# EasyEDA Pro project Jarvis.eprj, board PCB60
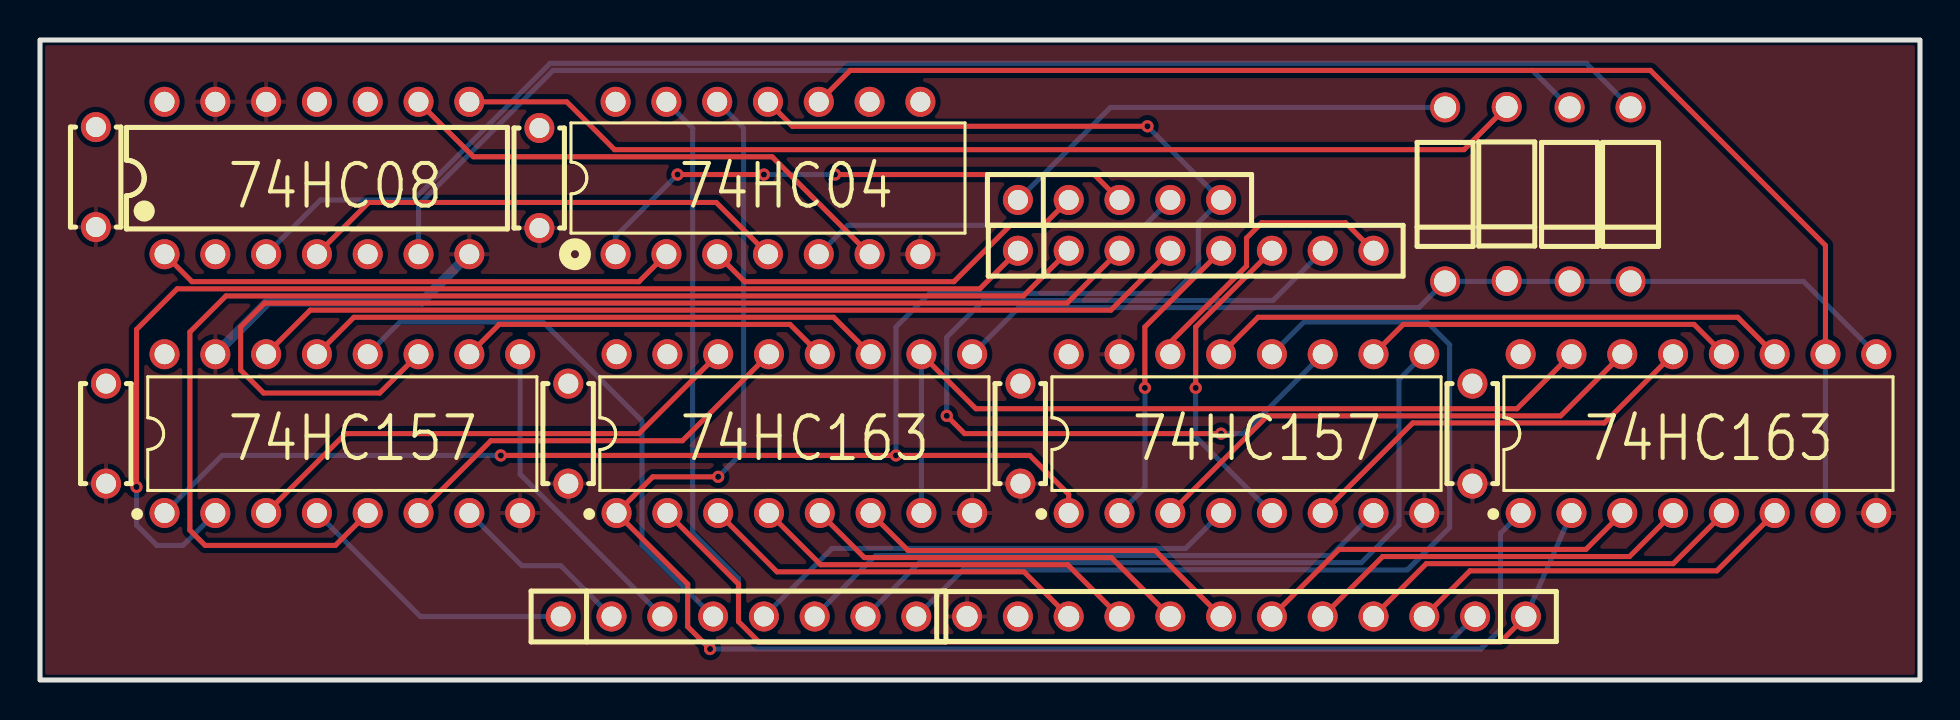
[diagram p12: board, top side]
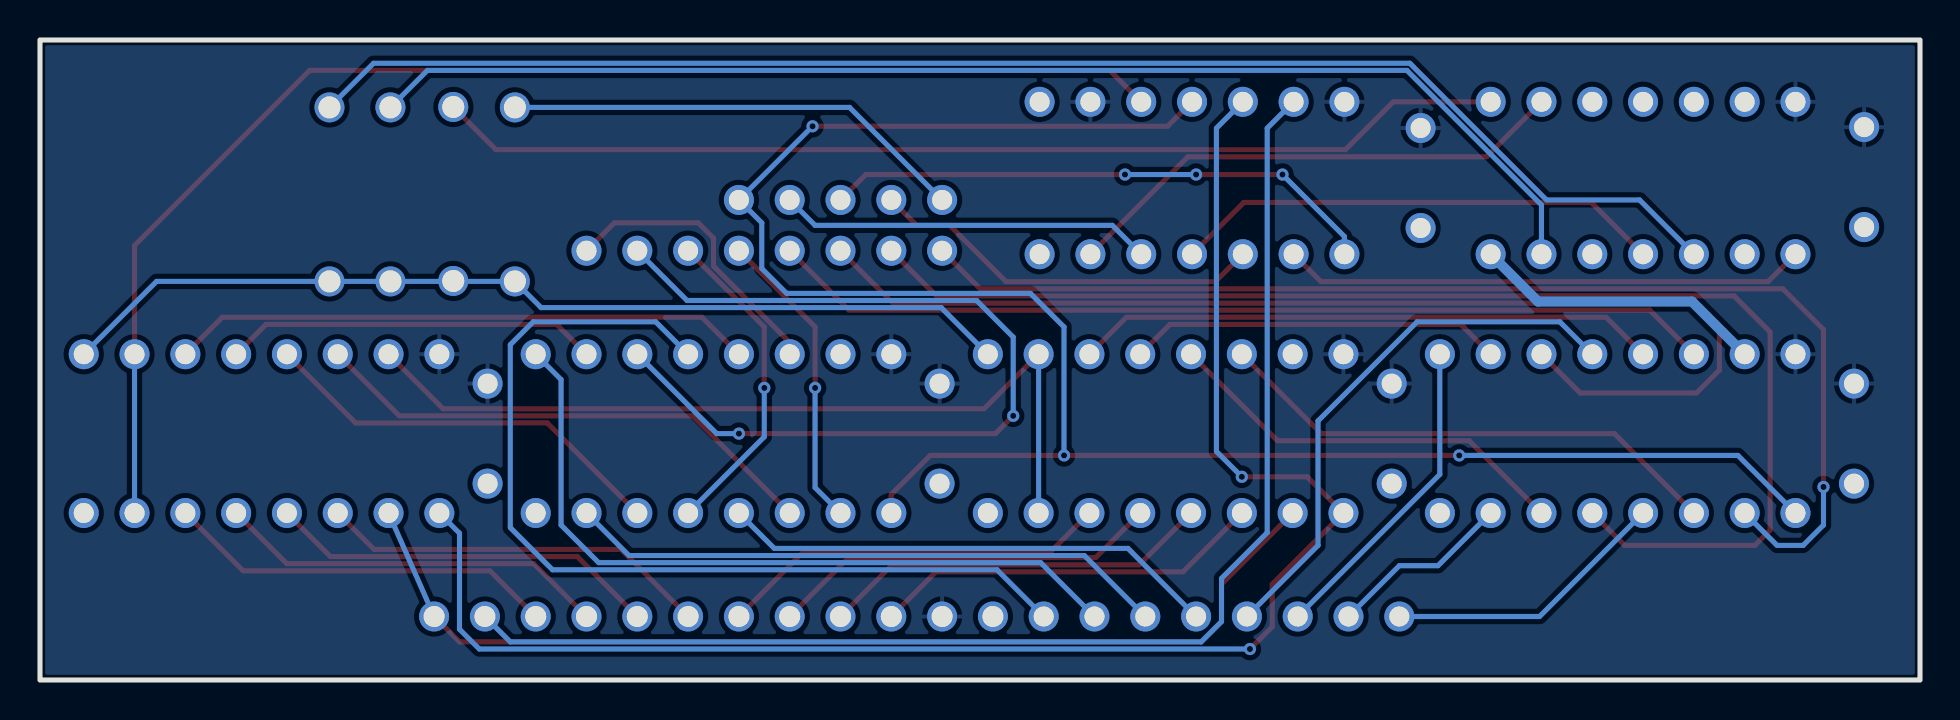
[diagram p13: board, bottom side, seen from below]

Outline 94 x 32 mm; copper layers: Top Layer, Bottom Layer. Coordinates in mm from the lower left corner of the outline.
Outline path: rectangle 0,32 94,0
Stack: Top Layer 0.035mm / Dielectric1 1.51mm FR4 er 4.5 / Bottom Layer 0.035mm

## Design rules (mm)
template: JLCPCB Capability(Two Layers Board)
spacing copperThickness1oz (default): track to track 0.102, other pairs 0.152 to 0.3
spacing copperThickness2oz: track to track 0.203, other pairs 0.152 to 0.3
track width copperThickness1oz (default): min 0.127, default 0.254, max 2.54
track width copperThickness2oz: min 0.203, default 0.254, max 2.54
differential pair differentialPair (default): width min 0.127, default 0.254, max 2.54; gap min 0.152, default 0.152
via viaSize (default): diameter min 0.5, default 0.61, max 10; hole min 0.3, default 0.305, max 6.3

## Placement (name value [footprint] x y rotation side)
C61  100nF  [CAP-TH_L5.0-W2.5-P5.00-D1.0]  71.62 12.32 270 top
C62  100nF  [CAP-TH_L5.0-W2.5-P5.00-D1.0]  24.97 25.1 270 top
C63  100nF  [CAP-TH_L5.0-W2.5-P5.00-D1.0]  3.3 12.32 270 top
C64  100nF  [CAP-TH_L5.0-W2.5-P5.00-D1.0]  2.79 25.15 270 top
C65  100nF  [CAP-TH_L5.0-W2.5-P5.00-D1.0]  49.02 12.32 270 top
C66  100nF  [CAP-TH_L5.0-W2.5-P5.00-D1.0]  26.42 12.32 270 top
U210  SN74HC04N(LX)  [DIP-14_L19.6-W6.4-P2.54-LS7.6-BL]  36.4 25.1 0 top
U321  SN74HC163NE4  [PDIP-16_L19.3-W6.4-P2.54-LS7.94-BL]  37.72 12.32 0 top
U322  MC74HC157AN  [PDIP-16_L19.3-W6.4-P2.54-LS7.94-BL]  15.12 12.32 0 top
U323  SN74HC163NE4  [PDIP-16_L19.3-W6.4-P2.54-LS7.94-BL]  82.92 12.32 0 top
U324  MC74HC157AN  [PDIP-16_L19.3-W6.4-P2.54-LS7.94-BL]  60.32 12.32 0 top
U325  SN74HC08NE4  [PDIP-14_L19.3-W6.5-P2.54-LS7.6-BL]  13.85 25.1 0 top
U353  1N4007-DIODE  [DO-41_BD2.4-L4.7-P8.70-D0.8-FD]  73.34 24.3 270 top
U354  1N4007-DIODE  [DO-41_BD2.4-L4.7-P8.70-D0.8-FD]  76.48 24.28 270 top
U355  1N4007-DIODE  [DO-41_BD2.4-L4.7-P8.70-D0.8-FD]  79.53 24.28 270 top
U356  TH2.54_8P_0.6  [HDR-TH_8P-P2.54-V-M-3]  57.78 21.46 0 top
U359  1N4007-DIODE  [DO-41_BD2.4-L4.7-P8.70-D0.8-FD]  70.26 24.28 270 top
U386  D22030200553-HDR-TH_12P-P2.54-V-F  [HDR-TH_12P-P2.54-V-F]  60.32 3.17 180 top
U387  TH2.54_8P_0.6  [HDR-TH_8P-P2.54-V-M-3]  34.93 3.17 0 top
U388  TH2.54_8P_0.6  [HDR-TH_5P-P2.54-V-F-R1-C5-S2.54]  53.97 24 0 top

## Footprints (pads in the part's own frame, mm; a bottom-side part is the same pattern mirrored in y, then rotated)
CAP-TH_L5.0-W2.5-P5.00-D1.0
  round 1.5 hole 1: 1(-2.5,0) 2(2.5,0)
DIP-14_L19.6-W6.4-P2.54-LS7.6-BL
  round 1.5 hole 1: 1(-7.62,-3.81) 2(-5.08,-3.81) 3(-2.54,-3.81) 4(0,-3.81) 5(2.54,-3.81) 6(5.08,-3.81) 7(7.62,-3.81) 8(7.62,3.81) 9(5.08,3.81) 10(2.54,3.81) 11(0,3.81) 12(-2.54,3.81) 13(-5.08,3.81) 14(-7.62,3.81)
DO-41_BD2.4-L4.7-P8.70-D0.8-FD
  round 1.5 hole 1.1x1: 1(-4.35,0) 2(4.35,0)
HDR-TH_5P-P2.54-V-F-R1-C5-S2.54
  round 1.5 hole 1: 1(-5.08,0) 2(-2.54,0) 3(0,0) 4(2.54,0) 5(5.08,0)
HDR-TH_8P-P2.54-V-M-3
  round 1.5 hole 1: 1(-8.89,0) 2(-6.35,0) 3(-3.81,0) 4(-1.27,0) 5(1.27,0) 6(3.81,0) 7(6.35,0) 8(8.89,0)
HDR-TH_12P-P2.54-V-F
  round 1.5 hole 1.05x1: 1(-13.97,0) 2(-11.43,0) 3(-8.89,0) 4(-6.35,0) 5(-3.81,0) 6(-1.27,0) 7(1.27,0) 8(3.81,0) 9(6.35,0) 10(8.89,0) 11(11.43,0) 12(13.97,0)
PDIP-14_L19.3-W6.5-P2.54-LS7.6-BL
  round 1.5 hole 1: 1(-7.62,-3.81) 2(-5.08,-3.81) 3(-2.54,-3.81) 4(0,-3.81) 5(2.54,-3.81) 6(5.08,-3.81) 7(7.62,-3.81) 8(7.62,3.81) 9(5.08,3.81) 10(2.54,3.81) 11(0,3.81) 12(-2.54,3.81) 13(-5.08,3.81) 14(-7.62,3.81)
PDIP-16_L19.3-W6.4-P2.54-LS7.94-BL
  round 1.5 hole 1: 1(-8.89,-3.97) 2(-6.35,-3.97) 3(-3.81,-3.97) 4(-1.27,-3.97) 5(1.27,-3.97) 6(3.81,-3.97) 7(6.35,-3.97) 8(8.89,-3.97) 9(8.89,3.97) 10(6.35,3.97) 11(3.81,3.97) 12(1.27,3.97) 13(-1.27,3.97) 14(-3.81,3.97) 15(-6.35,3.97) 16(-8.89,3.97)

## Nets
As in the schematic, except:
C-FLAG-OUT: U325.10
JC: U210.5 U388.4
JMP: U359.1 U388.1
JN: U210.1 U388.3
JZ: U210.3 U388.2
N-FLAG-OUT: U325.2
RUN: U210.11 U322.1 U324.1 U388.5
Z-FLAG-OUT: U325.5

Pads without a net: U210 8; U321 15; U325 11

## Via types
v1: diameter 0.61, hole 0.305, Top Layer to Bottom Layer, 13 vias

## Routing (per net, layer and track width the routed paths; a pad name or vN(x,y) marks a point on that pad's centre or on a via; arc(x,y) is an arc through that point)
GND: length 14.8
  Bottom Layer w0.5: U325.7 19.1,18.92 11.4,18.92 U322.15
CLK: length 52.9
  Top Layer w0.254: U386.1 73.03,1.91 35.94,1.91 34.93,2.92 34.93,4.79 U321.2
  Bottom Layer w0.254: U386.1 U323.2
CO0: length 25.9
  Top Layer w0.254: U322.3 15.28,12.32 29.94,12.32 U321.14
CO1: length 20.8
  Top Layer w0.254: U322.6 22.54,11.96 32.12,11.96 U321.13
CO2: length 18.8
  Top Layer w0.254: U322.10 22.96,17.78 37.5,17.78 U321.12
CO3: length 29.2
  Top Layer w0.254: U321.11 39.68,18.14 15.69,18.14 U322.13
CO4: length 25.9
  Top Layer w0.254: U323.14 76.03,13.21 61.37,13.21 U324.3
CO5: length 20.8
  Top Layer w0.254: U324.6 68.64,12.85 78.22,12.85 U323.13
CO6: length 18.8
  Top Layer w0.254: U323.12 82.7,17.78 68.17,17.78 U324.10
CO7: length 29.2
  Top Layer w0.254: U323.11 84.89,18.14 60.9,18.14 U324.13
DATA0: length 19.7
  Top Layer w0.254: U321.3 36.85,5.41 49.2,5.41 U386.10
DATA1: length 19.7
  Top Layer w0.254: U386.9 51.38,5.77 39.03,5.77 U321.4
DATA2: length 19.7
  Top Layer w0.254: U386.8 53.57,6.12 41.22,6.12 U321.5
DATA3: length 19.7
  Top Layer w0.254: U321.6 43.4,6.48 55.75,6.48 59.06,3.17
DATA4: length 19.7
  Top Layer w0.254: U323.3 77.29,6.53 64.95,6.53 U386.6
DATA5: length 19.7
  Top Layer w0.254: U386.5 67.13,6.17 79.48,6.17 U323.4
DATA6: length 19.7
  Top Layer w0.254: U323.5 81.66,5.82 69.32,5.82 66.68,3.17
DATA7: length 19.7
  Top Layer w0.254: U323.6 83.84,5.46 71.5,5.46 69.22,3.17
DP0: length 60.5
  Top Layer w0.254: v1(4.83,9.65) 4.83,17.53 6.86,19.56 46.99,19.56 48.9,21.46
  Bottom Layer w0.254: v1(4.83,9.65) 4.83,7.75 5.84,6.73 7.15,6.73 U322.2
DP1: length 65.4
  Top Layer w0.254: U322.5 14.77,6.73 8.25,6.73 7.49,7.49 7.49,17.4 9.3,19.2 49.18,19.2 U356.2
DP2: length 57.8
  Top Layer w0.254: U322.11 16.99,14.35 11.18,14.35 10.03,15.49 10.03,17.65 11.23,18.85 51.36,18.85 U356.3
DP3: length 47.4
  Top Layer w0.254: U322.14 13.51,18.49 53.54,18.49 U356.4
DP4: length 15.2
  Top Layer w0.254: v1(55.25,14.61) 55.25,17.65 U356.5
  Bottom Layer w0.254: U324.2 55.25,9.62 v1(55.25,14.61)
DP5: length 16.3
  Top Layer w0.254: v1(57.78,14.61) 57.78,17.65 U356.6
  Bottom Layer w0.254: U324.5 57.78,12.16 v1(57.78,14.61)
DP6: length 45.3
  Top Layer w0.254: v1(45.34,13.21) 46.23,12.32 v1(59.06,12.32)
  Bottom Layer w0.254: v1(59.06,12.32) 60.16,12.32 U324.11 ; v1(45.34,13.21) 45.34,17.14 47.17,18.97 61.65,18.97 U356.7
DP7: length 14.6
  Top Layer w0.254: U324.14 56.51,16.89 60.32,20.7 60.32,22.1 61.09,22.86 65.28,22.86 U356.8
JC: length 18.7
  Bottom Layer w0.254: U210.5 40.38,22.73 55.25,22.73 U388.4
JC#: length 25.7
  Top Layer w0.254: U210.6 36.61,26.16 21.67,26.16 U325.9
JMP: length 23.3
  Bottom Layer w0.254: U359.1 53.52,28.63 48.9,24
JN: length 27.9
  Top Layer w0.254: U388.3 52.71,25.27 v1(39.75,25.27) ; v1(36.19,25.27) v1(31.88,25.27)
  Bottom Layer w0.254: U210.1 28.78,22.18 v1(31.88,25.27) ; v1(39.75,25.27) v1(36.19,25.27)
JN#: length 26.2
  Top Layer w0.254: U210.2 29.95,19.92 7.6,19.92 U325.1
JZ: length 19.8
  Top Layer w0.254: U210.3 35.23,19.92 45.7,19.92 48.51,22.73 50.16,22.73 U388.2
JZ#: length 24.7
  Top Layer w0.254: U210.4 33.81,23.88 16.43,23.88 U325.4
PA0: length 14.3
  Bottom Layer w0.254: U387.1 19.02,3.17 U322.4
PA1: length 9.3
  Bottom Layer w0.254: U322.7 24.1,5.72 26.03,5.72 28.57,3.17
PA2: length 16.1
  Bottom Layer w0.254: U387.3 24.01,10.28 U322.9
PA3: length 27.7
  Bottom Layer w0.254: U387.4 30.1,6.73 30.1,12.95 25.15,17.91 18,17.91 U322.12
PA4: length 25
  Bottom Layer w0.254: U324.4 57.28,6.58 39.6,6.58 U387.5
PA5: length 30.1
  Bottom Layer w0.254: U387.6 41.78,6.22 64.55,6.22 U324.7
PA6: length 37.6
  Bottom Layer w0.254: U387.7 43.97,5.87 66.06,5.87 67.94,7.75 67.94,15.02 U324.9
PA7: length 47.7
  Bottom Layer w0.254: U387.8 46.15,5.51 68.38,5.51 70.49,7.62 70.49,16.76 69.34,17.91 63.21,17.91 U324.12
PI: length 48.2
  Bottom Layer w0.254: U323.9 88.17,19.93 U355.2 U354.2 U359.2 68.94,18.62 48.94,18.62 U321.9
RST: length 65.3
  Bottom Layer w0.254: U210.13 32.64,27.59 32.64,7.37 34.93,5.08 34.93,2.92 35.94,1.91 70.49,1.91 U386.2
RST#: length 80.5
  Top Layer w0.254: v1(33.5,1.55) 32.38,2.67 32.38,4.79 U321.1 30.64,10.16 v1(33.91,10.16)
  Bottom Layer w0.254: v1(33.91,10.16) 35.18,11.43 35.18,27.59 U210.12 ; 74.03,8.35 73.03,7.34 73.03,2.54 72.03,1.55 v1(33.5,1.55)
RUN: length 99.5
  Top Layer w0.254: U324.1 51.43,9.28 49.49,11.23 v1(42.8,11.23) v1(23.04,11.23) ; v1(55.37,27.69) 37.62,27.69 U210.11
  Bottom Layer w0.254: v1(55.37,27.69) U388.5 57.91,22.86 57.91,20.57 56.67,19.33 44.48,19.33 42.8,17.65 42.8,11.23 ; v1(23.04,11.23) 9.11,11.23 U322.1
RUN#: length 68
  Top Layer w0.254: U323.10 89.27,21.72 80.52,30.48 40.51,30.48 U210.10
  Bottom Layer w0.254: U323.10 U323.7
$1N798: length 63.6
  Bottom Layer w0.254: U325.6 18.93,23.75 25.65,30.48 74.63,30.48 U354.1
$1N830: length 73.1
  Bottom Layer w0.254: U355.1 77.32,30.84 25.51,30.84 18.67,24 14.02,24 U325.3
$1N833: length 53.7
  Top Layer w0.254: U353.1 71.2,26.52 28.73,26.52 26.34,28.91 U325.8
$1N887: length 42.7
  Top Layer w0.254: U321.10 46.79,13.56 73.85,13.56 U323.15
  Bottom Layer w0.254: U321.7 U321.10

## Copper pours and planes (outline as drawn; the poured copper is in the pictures)
GND on Top Layer: 0,32 94,32 94,0 0,0
VCC on Bottom Layer: 0,32 94,32 94,0 0,0

## Text on the board
Top Silkscreen Layer: 74HC08 | 74HC157 | 74HC04 | 74HC163
